# EasyEDA Pro project M0G3507逐飞主板.eprj, board pcb
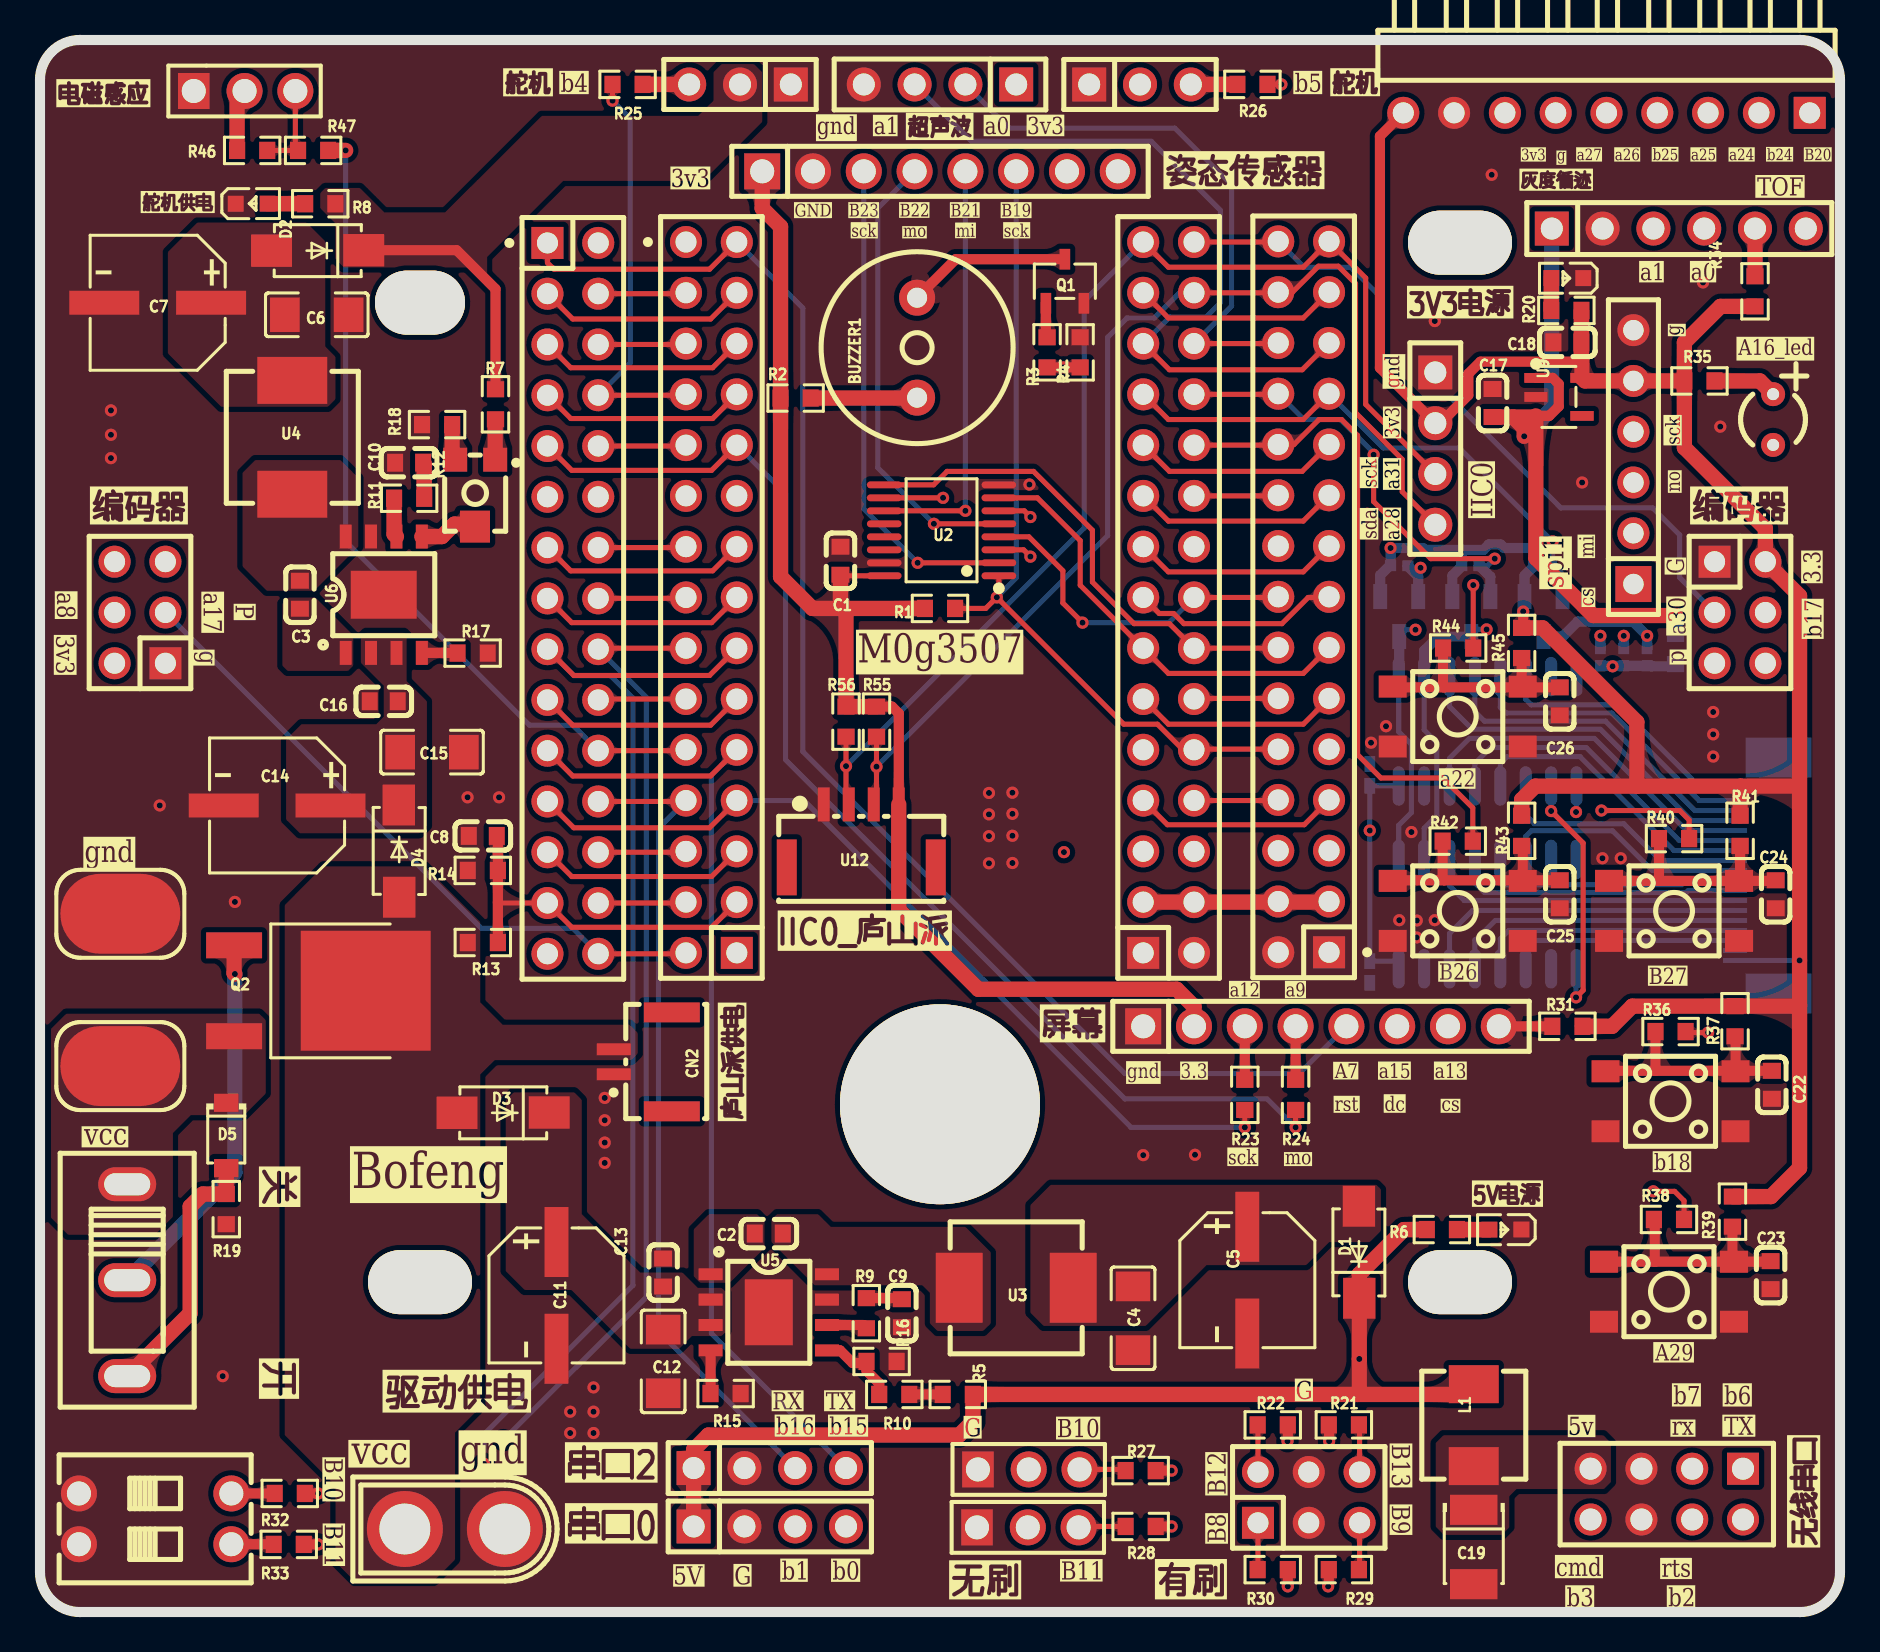
[diagram p4: board, top side]
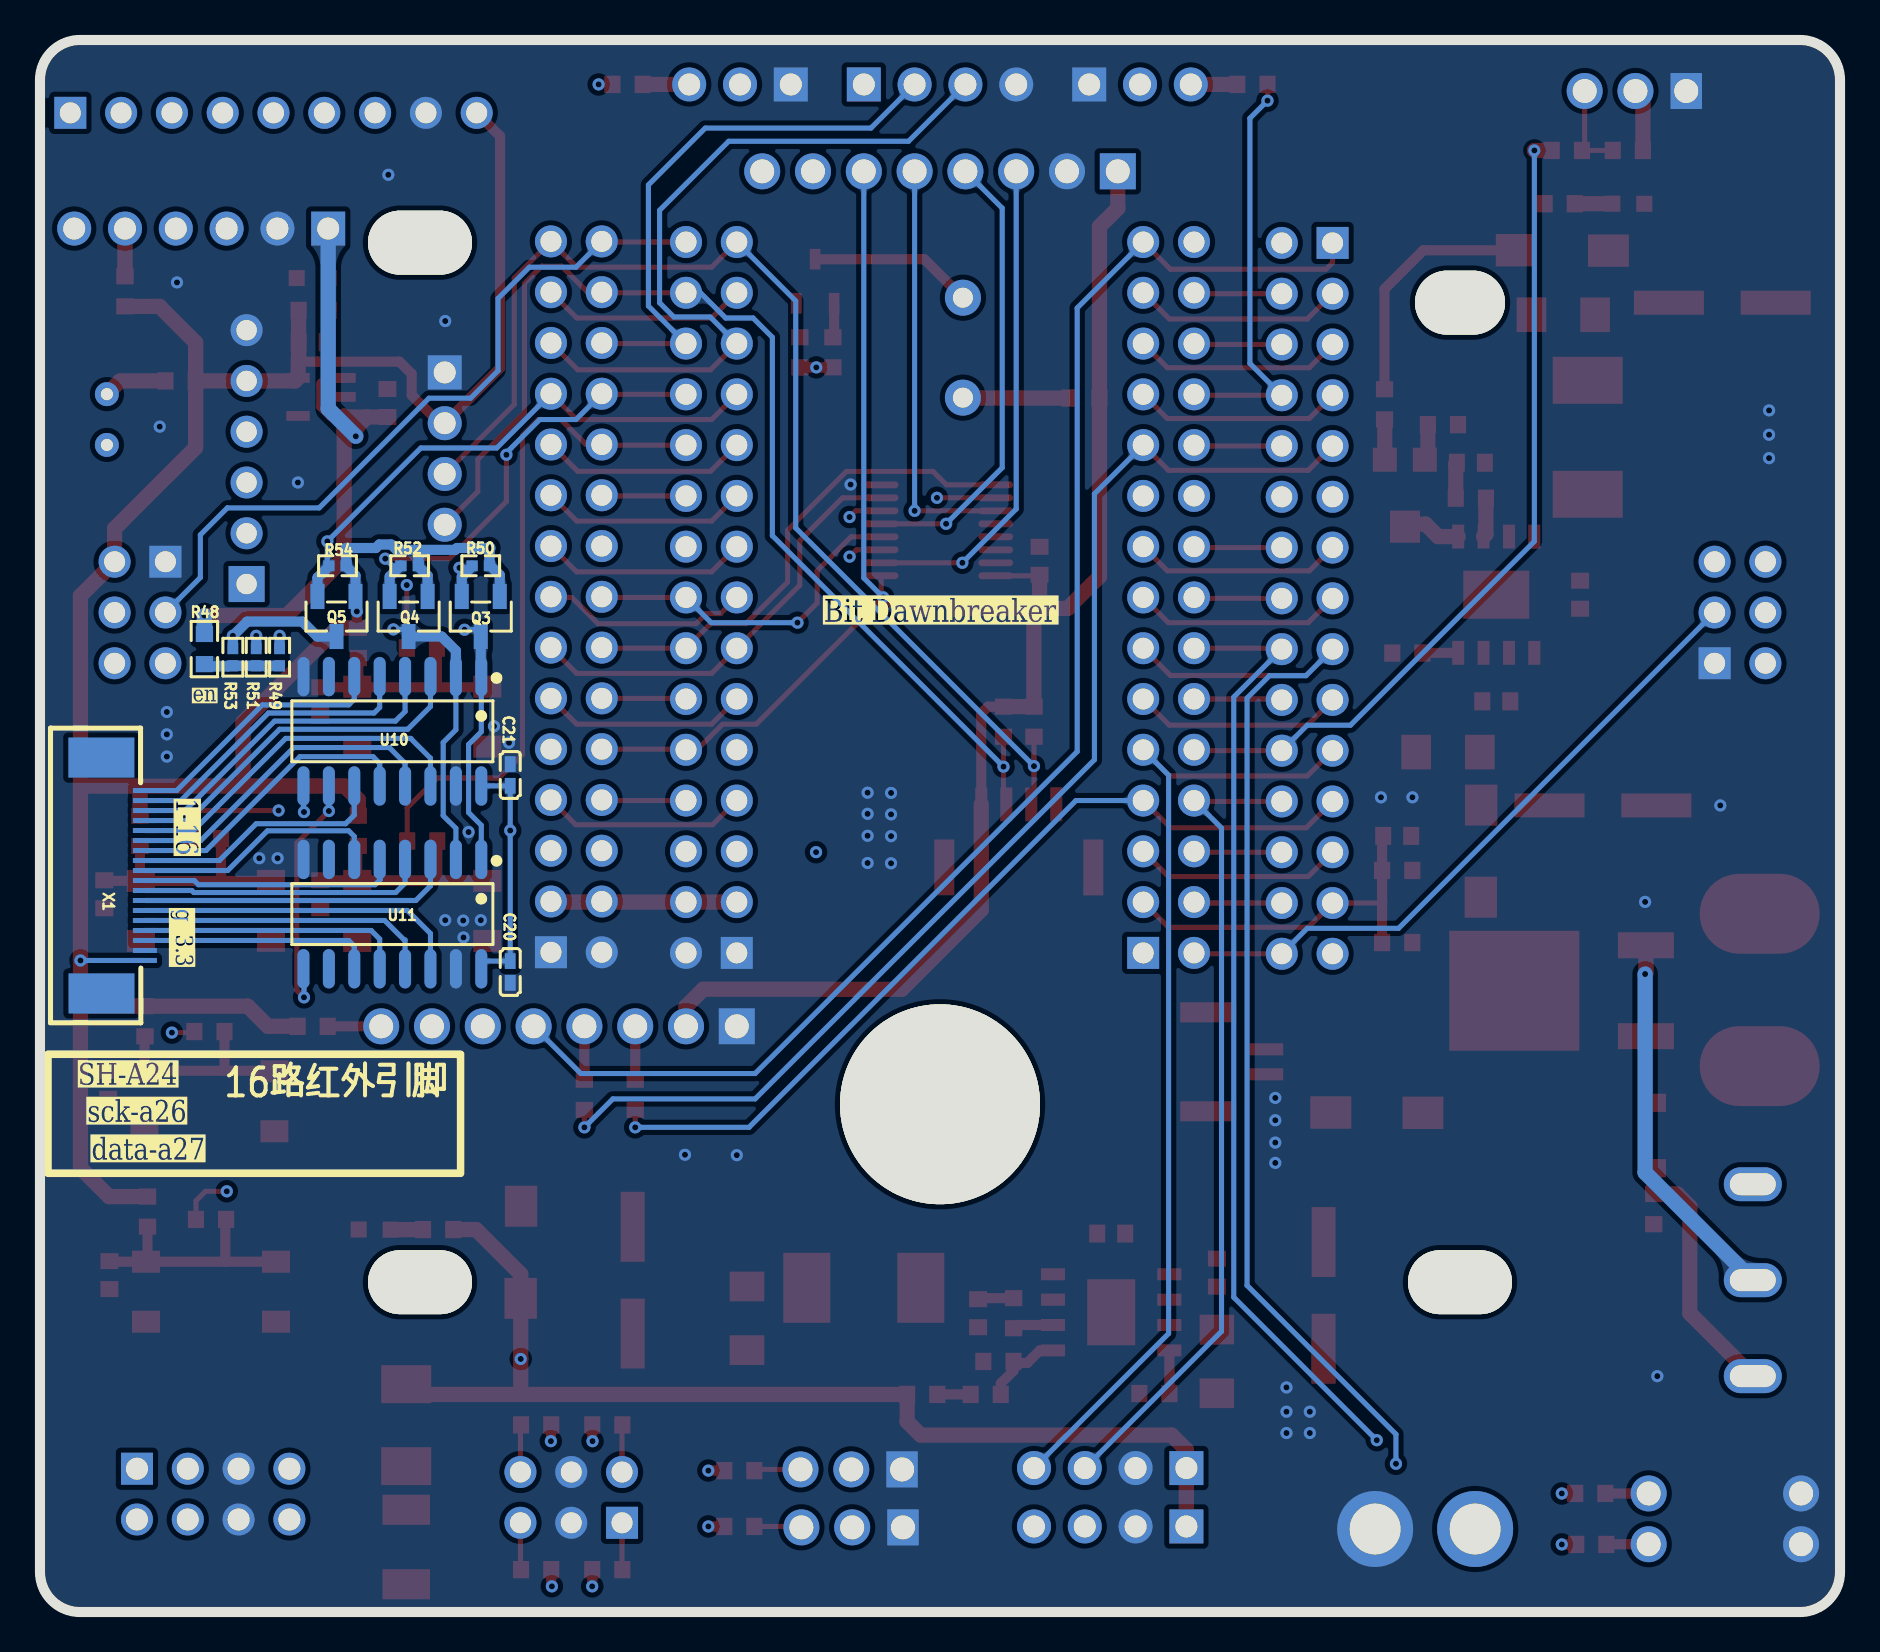
[diagram p5: board, bottom side, seen from below]

Outline 90 x 78.64 mm; copper layers: Top Layer, Inner1, Inner2, Bottom Layer. Coordinates in mm from the lower left corner of the outline.
Outline path: 0,76.64 0,2 arc(0.59,0.59) 2,0 88,0 arc(89.41,0.59) 90,2 90,76.64 arc(89.41,78.05) 88,78.64 2,78.64 arc(0.59,78.05) 0,76.64
Stack: Top Layer 0.035mm 外层铜厚1oz / Dielectric1 0.2104mm 7628 RC49% 8.6mil / Inner1 0.0152mm 内层铜厚 / Dielectric2 1.065mm 1.1mm H/HOZ Copper / Inner2 0.0152mm 内层铜厚 / Dielectric3 0.2104mm 7628 RC49% 8.6mil / Bottom Layer 0.035mm 外层铜厚1oz

## Design rules (mm)
template: 自用
spacing copperThickness1oz (default): track to track 0.102, other pairs 0.152 to 0.3
spacing copperThickness2oz: track to track 0.203, other pairs 0.152 to 0.3
track width copperThickness1oz (default): min 0.127, default 0.254, max 2.54
track width copperThickness2oz: min 0.203, default 0.254, max 2.54
track width Power_high: min 0.254, default 1.524, max 3.81
track width Power_low: min 0.254, default 0.762, max 2.54
differential pair differentialPair (default): width min 0.127, default 0.254, max 2.54; gap min 0.152, default 0.152
via viaSize (default): diameter min 0.5, default 0.61, max 10; hole min 0.3, default 0.305, max 6.299
net +5V uses Power_low
net 3V3 uses Power_low

## Placement (name value [footprint] x y rotation side)
BUZZER1  3kHz  [BUZ-TH_BD9.6-P5.00-D0.7-FD]  43.86 63.25 90 top
C1  100nF  [C0603]  40.02 52.59 270 top
C2  100nF  [C0603]  36.44 18.93 0 top
C3  100nF  [C0603]  13 50.89 90 top
C4  47uF  [C1206]  54.65 14.69 90 top
C5  100uF  [CAP-SMD_BD6.3-L6.6-W6.6-LS7.6-FD-1]  60.37 16.6 270 top
C6  47uF  [C1206]  13.84 64.89 180 top
C7  100uF  [CAP-SMD_BD6.3-L6.6-W6.6-LS7.6-FD-1]  5.88 65.49 180 top
C8  100nF  [C0603]  22.14 38.82 180 top
C9  4.7nF  [C0603]  43.09 14.95 270 top
C10  4.7nF  [C0603]  18.46 57.49 180 top
C11  100uF  [CAP-SMD_BD6.3-L6.6-W6.6-LS7.6-FD-1]  25.82 15.84 270 top
C12  4.7uF  [C1206]  31.16 12.53 90 top
C13  100nF  [C0603]  31.16 16.98 270 top
C14  100uF  [CAP-SMD_BD6.3-L6.6-W6.6-LS7.6-FD-1]  11.85 40.35 180 top
C15  4.7uF  [C1206]  19.6 43.02 180 top
C16  100nF  [C0603]  17.19 45.56 0 top
C17  10uF  [C0603]  72.63 60.48 270 top
C18  10uF  [C0603]  76.37 63.51 0 top
C19  47uF  [CASE-B_3528]  71.69 3.25 270 top
C20  100nF  [C0402]  66.49 32.02 270 bottom
C21  100nF  [C0402]  66.49 41.87 90 bottom
C22  100nF  [C0603]  86.59 26.37 90 top
C23  100nF  [C0603]  86.53 16.85 90 top
C24  100nF  [C0603]  86.78 35.9 90 top
C25  100nF  [C0603]  75.99 35.9 90 top
C26  100nF  [C0603]  75.99 45.56 90 top
CN1  XT30U-M  [CONN-TH_XT30U-M]  20.74 4.15 0 top
CN2  WAFER-GH1.25-2PWB  [CONN-TH_2P-P1.25_XUNPU_WAFER-GH1.25-2PWB]  30.14 27.52 90 top
D1  SS54  [SMA_L4.3-W2.6-LS5.0-FD]  65.96 18 270 top
D2  SS54  [SMA_L4.3-W2.6-LS5.0-FD]  13.88 68.11 0 top
D3  SS54  [SMA_L4.3-W2.6-LS5.0-FD]  23.16 24.98 0 top
D4  SS54  [SMA_L4.3-W2.6-LS5.0-FD]  17.95 38.06 90 top
D5  BZT52C16  [SOD-123_L2.7-W1.6-LS3.7-RD]  9.31 23.84 270 top
H1  X6521WV-2x15H-C60D30  [HDR-TH_30P-P2.54-V-M-R2-C15-S2.54-BL]  63.18 50.78 90 top
H2  X6521WV-2x15H-C60D30  [HDR-TH_30P-P2.54-V-M-R2-C15-S2.54-BL]  26.64 50.71 270 top
H3  -  [HDR-TH_3P-P2.54-V-M]  35 76.41 180 top
H4  -  [HDR-TH_3P-P2.54-V-M]  55 76.41 0 top
H5  PM254V-12-08-H85  [HDR-TH_8P-P2.54-V-F-R2-C4-S2.54]  81.34 5.9 180 top
H6  2.54-1*3P针  [HDR-TH_3P-P2.54-V-M-1]  49.44 7.13 0 top
H7  2.54-1*3P针  [HDR-TH_3P-P2.54-V-M-1]  49.39 4.23 0 top
H8  2.54-2*3  [HDR-TH_6P-P2.54-V-R2-C3-S2.54_A2541WV-2X3P]  63.44 5.73 0 top
H9  2.54-2*3  [HDR-TH_6P-P2.54-V-R2-C3-S2.54_A2541WV-2X3P]  5 50 90 top
H10  2.54-2*3  [HDR-TH_6P-P2.54-V-R2-C3-S2.54_A2541WV-2X3P]  85 50 270 top
H11  HC-PZ254-13.8L-1x9PWA  [HDR-TH_9P-P2.54-H-M-W10.4-N]  78.32 74.99 180 top
H12  -  [HDR-TH_4P-P2.54-V-F]  45 76.41 180 top
H13  PZ254V-11-06P  [HDR-TH_6P-P2.54-V-M]  81.94 69.2 0 top
H14  2.54-1*3P针  [HDR-TH_3P-P2.54-V-M-1]  10.23 76.09 0 top
H15  -  [HDR-TH_4P-P2.54-V-F]  69.76 58.2 270 top
H16  KH-2.54PH180-1X4P-L11.5  [HDR-TH_4P-P2.54-V-M]  36.49 4.28 0 top
H17  KH-2.54PH180-1X4P-L11.5  [HDR-TH_4P-P2.54-V-M]  36.49 7.2 0 top
H18  -  [HDR-TH_6P-P2.54-V-F]  79.67 57.77 90 top
L1  4.7uH  [IND-SMD_L5.4-W5.2_FXL0530]  71.69 9.35 270 top
LED1  19-213/Y2C-CQ2R2L/3T(CY)  [LED0603-RD-YELLOW]  73.27 19.13 180 top
LED2  19-213/Y2C-CQ2R2L/3T(CY)  [LED0603-RD-YELLOW]  10.58 70.45 0 top
LED3  KT-0603R  [LED0603-RD]  76.37 66.73 180 top
LED4  TLHR4200  [LED-TH_BD3.2-P2.54-FD]  86.66 59.65 270 top
NOREF  -  [Pad_e3680]  19 16.5 90 top
NOREF#2  -  [Pad_e3679]  71 68.5 90 top
NOREF#3  -  [Pad_e2316]  45 25.4 0 top
NOREF#4  -  [Pad_e3681]  71 16.5 90 top
NOREF#5  -  [Pad_e3675]  19 65.5 90 top
P1  2.54-1*8P母环保  [HDR-TH_8P-P2.54-V-F-1]  64.05 29.3 0 top
P2  2.54-1*8P母环保  [HDR-TH_8P-P2.54-V-F-1]  45 72.07 0 top
Q1  S8050 J3Y(RANGE:200-350)  [SOT-23-3_L3.0-W1.7-P0.95-LS2.9-BR]  51.24 66.57 270 top
Q2  HY19P03D  [TO-252-2_L6.6-W6.1-P4.57-LS9.9-TL-CW]  13 31.08 0 top
Q3  AO3400A  [SOT-23-3_L2.9-W1.3-P1.90-LS2.4-BR]  67.96 49.8 90 bottom
Q4  AO3400A  [SOT-23-3_L2.9-W1.3-P1.90-LS2.4-BR]  71.57 49.8 90 bottom
Q5  AO3400A  [SOT-23-3_L2.9-W1.3-P1.90-LS2.4-BR]  75.18 49.8 90 bottom
R1  10K  [R0603]  45 50.2 180 top
R2  10Ω  [R0603]  37.78 60.73 0 top
R3  4.7kΩ  [R0603]  50.35 63.01 90 top
R4  4.7kΩ  [R0603]  52 63.01 90 top
R5  51kΩ  [R0603]  45.89 10.88 0 top
R6  10k  [R0603]  70.09 19.13 180 top
R7  27k  [R0603]  22.78 60.41 90 top
R8  10k  [R0603]  14.01 70.45 0 top
R9  20kΩ  [R0603]  41.32 14.95 270 top
R10  1.5kΩ  [R0603]  42.71 10.88 0 top
R11  20kΩ  [R0603]  18.46 55.72 180 top
R12  50K  [RES-ADJ-SMD_3P-L3.8-W3.7_VGF39NCHXT]  21.76 55.97 90 top
R13  10K  [R0603]  22.14 33.49 0 top
R14  1k  [R0603]  22.14 37.1 180 top
R15  200kΩ  [R0603]  34.28 10.93 0 top
R16  10kΩ  [R0603]  42.08 12.53 180 top
R17  200kΩ  [R0603]  21.63 47.97 0 top
R18  8.2  [R0603]  19.85 59.4 0 top
R19  10kΩ  [R0603]  9.31 20.16 90 top
R20  4.7kΩ  [R0603]  76.32 65.11 0 top
R21  100Ω  [R0603]  65.19 9.36 0 top
R22  100Ω  [R0603]  61.64 9.36 0 top
R23  100Ω  [R0603]  60.24 25.87 90 top
R24  100Ω  [R0603]  62.78 25.87 90 top
R25  10K  [R0603]  29.38 76.42 180 top
R26  10K  [R0603]  60.62 76.42 0 top
R27  100Ω  [R0603]  55.03 7.07 180 top
R28  100Ω  [R0603]  55.03 4.28 180 top
R29  100Ω  [R0603]  65.19 2.12 0 top
R30  100Ω  [R0603]  61.64 2.12 0 top
R31  1KΩ  [R0603]  76.37 29.3 0 top
R32  100Ω  [R0603]  12.49 5.93 180 top
R33  100Ω  [R0603]  12.44 3.38 180 top
R34  10K  [R0603]  85.75 66.06 270 top
R35  10K  [R0603]  82.97 61.58 0 top
R36  100Ω  [R0603]  81.53 29.04 0 top
R37  10K  [R0603]  84.75 29.55 90 top
R38  100Ω  [R0603]  81.45 19.64 0 top
R39  10K  [R0603]  84.62 20.03 90 top
R40  100Ω  [R0603]  81.7 38.69 0 top
R41  10K  [R0603]  85 39.08 90 top
R42  100Ω  [R0603]  70.89 38.56 0 top
R43  10K  [R0603]  74.08 39.08 90 top
R44  100Ω  [R0603]  70.91 48.22 0 top
R45  10K  [R0603]  74.08 48.48 90 top
R46  10KΩ  [R0603]  10.61 73.11 180 top
R47  100  [R0603]  13.66 73.11 0 top
R48  10K  [R0603]  81.78 48.17 90 bottom
R49  10K  [R0402]  78.02 47.77 270 bottom
R50  4.7K  [R0402]  67.96 52.34 180 bottom
R51  10K  [R0402]  79.19 47.77 270 bottom
R52  4.7K  [R0402]  71.52 52.34 180 bottom
R53  10K  [R0402]  80.36 47.77 270 bottom
R54  4.7K  [R0402]  75.12 52.34 180 bottom
R55  1.5K  [R0603]  41.82 44.54 90 top
R56  1.5K  [R0603]  40.3 44.54 90 top
SW1  SS12D10G6  [SW-TH_SHOU-HAN_SS12D10G4]  4.36 16.6 270 top
SW2  DSWB02LHGET  [SW-TH_DSWB02LHGET]  5.76 4.66 270 top
SW3  KH-4.5X4.5X3.8H-STM  [SW-SMD_4P-L4.5-W4.5-P3.00-LS6.8]  81.53 25.55 0 top
SW4  KH-4.5X4.5X3.8H-STM  [SW-SMD_4P-L4.5-W4.5-P3.00-LS6.8]  81.45 16.02 0 top
SW5  KH-4.5X4.5X3.8H-STM  [SW-SMD_4P-L4.5-W4.5-P3.00-LS6.8]  81.7 35.07 0 top
SW6  KH-4.5X4.5X3.8H-STM  [SW-SMD_4P-L4.5-W4.5-P3.00-LS6.8]  70.89 35.07 0 top
SW7  KH-4.5X4.5X3.8H-STM  [SW-SMD_4P-L4.5-W4.5-P3.00-LS6.8]  70.89 44.79 0 top
U1  -  [MSPM0G3507]  45 50.91 180 top
U2  CH440R  [TSSOP-16_L5.0-W4.4-P0.65-LS6.4-BL]  45.08 54.11 90 top
U3  4.7uH  [IND-SMD_L7.2-W6.6_GPSR07X0]  48.81 16.22 0 top
U4  4.7uH  [IND-SMD_L7.2-W6.6_GPSR07X0]  12.61 58.76 90 top
U5  SCT2450STER  [ESOP-8_L4.9-W3.9-P1.27-LS6.0-BL-EP]  36.44 14.99 270 top
U6  SCT2450STER  [ESOP-8_L4.9-W3.9-P1.27-LS6.0-BL-EP]  17.19 50.89 0 top
U7  -  [WIREPAD-4X6]  4.02 27.31 0 top
U8  -  [WIREPAD-4X6]  4.02 34.93 0 top
U9  RT9013-33GB  [SOT-23-5_L3.0-W1.7-P0.95-LS2.8-BL]  75.95 60.78 270 top
U10  SN74LS165ADR  [SOIC-16_L9.9-W3.9-P1.27-LS6.0-BL]  72.38 44.06 0 bottom
U11  SN74LS165ADR  [SOIC-16_L9.9-W3.9-P1.27-LS6.0-BL]  72.38 34.91 0 bottom
U12  WAFER-GH1.25-4PWB  [CONN-SMD_4P-P1.25_XUNPU_WAFER-GH1.25-4PWB]  41.06 38.82 0 top
X1  AFC07-S18FCA-00  [FPC-SMD_AFC07-S18FCA-00]  85.84 36.84 270 bottom

## Footprints (pads in the part's own frame, mm; a bottom-side part is the same pattern mirrored in y, then rotated)
BUZ-TH_BD9.6-P5.00-D0.7-FD
  round 1.8 hole 1: 1(-2.5,0) 2(2.5,0)
C0402
  rect 0.79x0.54 smd: 1(-0.545,0) 2(0.545,0)
C0603
  rect 0.8x0.9 smd: 1(-0.7,0) 2(0.7,0)
C1206
  rect 1.485x1.728 smd: 1(-1.593,0) 2(1.593,0)
CAP-SMD_BD6.3-L6.6-W6.6-LS7.6-FD-1
  rect 3.5x1.2 smd: 1(-2.67,0) 2(2.67,0)
CASE-B_3528
  rect 1.506x2.376 smd: 1(-1.861,0) 2(1.861,0)
CONN-SMD_4P-P1.25_XUNPU_WAFER-GH1.25-4PWB
  rect 0.6x1.7 smd: 1(-1.875,1.575) 2(-0.625,1.575) 3(0.625,1.575) 4(1.875,1.575)
  rect 1x2.8 smd: 5(3.725,-1.575) 6(-3.725,-1.575)
CONN-TH_2P-P1.25_XUNPU_WAFER-GH1.25-2PWB
  rect 0.6x1.7 smd: 1(-0.625,1.45) 2(0.625,1.45)
  rect 1x2.8 smd: 3(-2.475,-1.45) 4(2.475,-1.45)
CONN-TH_XT30U-M
  round 3.8 hole 2.54: 1(-2.5,0) 2(2.5,0)
ESOP-8_L4.9-W3.9-P1.27-LS6.0-BL-EP
  rect 0.6x1.2 smd: 1(-1.905,-2.909) 2(-0.635,-2.909) 3(0.635,-2.909) 4(1.905,-2.909) 5(1.905,2.909) 6(0.635,2.909) 7(-0.635,2.909) 8(-1.905,2.909)
  rect 3.3x2.4 smd: 9(0,0)
FPC-SMD_AFC07-S18FCA-00
  rect 0.25x1.2 smd: 1(-4.25,1.089) 2(-3.75,1.089) 3(-3.25,1.089) 4(-2.75,1.089) 5(-2.25,1.089) 6(-1.75,1.089) 7(-1.25,1.089) 8(-0.75,1.089) 9(-0.25,1.089) 10(0.25,1.089) 11(0.75,1.089) 12(1.25,1.089) 13(1.75,1.089) 14(2.25,1.089) 15(2.75,1.089) 16(3.25,1.089) 17(3.75,1.089) 18(4.25,1.089)
  rect 2x3.3 smd: 19(5.901,-1.081) 20(-5.901,-1.089)
HDR-TH_3P-P2.54-V-M
  rect 1.7x1.7 hole 1.1: 1(-2.54,0)
  round 1.7 hole 1.1: 2(0,0) 3(2.54,0)
HDR-TH_3P-P2.54-V-M-1
  rect 1.575x1.8 hole 1.2: 1(-2.54,0)
  round 1.8 hole 1.2: 2(0,0) 3(2.54,0)
HDR-TH_4P-P2.54-V-F
  rect 1.7x1.7 hole 1.1: 1(-3.81,0)
  round 1.7 hole 1.1: 2(-1.27,0) 3(1.27,0) 4(3.81,0)
HDR-TH_4P-P2.54-V-M
  rect 1.7x1.7 hole 1.1: 1(-3.81,0)
  round 1.7 hole 1.1: 2(-1.27,0) 3(1.27,0) 4(3.81,0)
HDR-TH_6P-P2.54-V-F
  rect 1.8x1.8 hole 1.02: 1(-6.35,0)
  round 1.6 hole 1.02: 2(-3.81,0) 3(-1.27,0) 4(1.27,0) 5(3.81,0) 6(6.35,0)
HDR-TH_6P-P2.54-V-M
  rect 1.7x1.7 hole 1.1: 1(-6.35,0)
  round 1.7 hole 1.1: 2(-3.81,0) 3(-1.27,0) 4(1.27,0) 5(3.81,0) 6(6.35,0)
HDR-TH_6P-P2.54-V-R2-C3-S2.54_A2541WV-2X3P
  rect 1.6x1.6 hole 1.05: 1(-2.54,-1.27)
  round 1.6 hole 1.05: 2(-2.54,1.27) 3(0,-1.27) 4(0,1.27) 5(2.54,-1.27) 6(2.54,1.27)
HDR-TH_8P-P2.54-V-F-1
  rect 1.8x1.8 hole 1.2: 1(-8.89,0)
  round 1.8 hole 1.2: 2(-6.35,0) 3(-3.81,0) 4(-1.27,0) 5(1.27,0) 6(3.81,0) 7(6.35,0) 8(8.89,0)
HDR-TH_8P-P2.54-V-F-R2-C4-S2.54
  rect 1.6x1.6 hole 1.1: 1(-3.81,-1.27)
  round 1.6 hole 1.1: 2(-3.81,1.27) 3(-1.27,-1.27) 4(-1.27,1.27) 5(1.27,-1.27) 6(1.27,1.27) 7(3.81,-1.27) 8(3.81,1.27)
HDR-TH_9P-P2.54-H-M-W10.4-N
  rect 1.6x1.6 hole 1.05: 1(-10.16,0)
  round 1.6 hole 1.05: 2(-7.62,0) 3(-5.08,0) 4(-2.54,0) 5(0,0) 6(2.54,0) 7(5.08,0) 8(7.62,0) 9(10.16,0)
HDR-TH_30P-P2.54-V-M-R2-C15-S2.54-BL
  rect 1.6x1.6 hole 1.05: 1(-17.78,-1.27)
  round 1.6 hole 1.05: 2(-17.78,1.27) 3(-15.24,-1.27) 4(-15.24,1.27) 5(-12.7,-1.27) 6(-12.7,1.27) 7(-10.16,-1.27) 8(-10.16,1.27) 9(-7.62,-1.27) 10(-7.62,1.27) 11(-5.08,-1.27) 12(-5.08,1.27) 13(-2.54,-1.27) 14(-2.54,1.27) 15(0,-1.27) 16(0,1.27) 17(2.54,-1.27) 18(2.54,1.27) 19(5.08,-1.27) 20(5.08,1.27) 21(7.62,-1.27) 22(7.62,1.27) 23(10.16,-1.27) 24(10.16,1.27) 25(12.7,-1.27) 26(12.7,1.27) 27(15.24,-1.27) 28(15.24,1.27) 29(17.78,-1.27) 30(17.78,1.27)
IND-SMD_L5.4-W5.2_FXL0530
  rect 1.9x2.5 smd: 1(-2.05,0) 2(2.05,0)
IND-SMD_L7.2-W6.6_GPSR07X0
  rect 2.35x3.5 smd: 1(-2.85,0) 2(2.85,0)
LED0603-RD
  rect 0.8x0.8 smd: 1(-0.799,0) 2(0.799,0)
LED0603-RD-YELLOW
  rect 0.8x0.8 smd: 1(-0.799,-0.004) 2(0.799,0.004)
LED-TH_BD3.2-P2.54-FD
  round 1.2 hole 0.6: 1(-1.27,0) 2(1.27,0)
MSPM0G3507
  round 1.6 hole 1.05: 1(-12.7,17.938) 3(-12.7,15.398) 4(-10.16,15.398) 5(-12.7,12.858) 6(-10.16,12.858) 7(-12.7,10.318) 8(-10.16,10.318) 9(-12.7,7.778) 10(-10.16,7.778) 11(-12.7,5.238) 12(-10.16,5.238) 13(-12.7,2.698) 14(-10.16,2.698) 15(-12.7,0.158) 16(-10.16,0.158) 17(-12.7,-2.382) 18(-10.16,-2.382) 19(-12.7,-4.922) 20(-10.16,-4.922) 21(-12.7,-7.462) 22(-10.16,-7.462) 23(-12.7,-10.002) 24(-10.16,-10.002) 25(-12.7,-12.542) 26(-10.16,-12.542) 27(-12.7,-15.082) 28(-10.16,-15.082) 29(-12.7,-17.622) 30(-10.16,-17.622) 31(12.7,-17.622) 32(10.16,-17.622) 33(12.7,-15.082) 34(10.16,-15.082) 35(12.7,-12.542) 36(10.16,-12.542) 37(12.7,-10.002) 38(10.16,-10.002) 39(12.7,-7.462) 40(10.16,-7.462) 41(12.7,-4.922) 42(10.16,-4.922) 43(12.7,-2.382) 44(10.16,-2.382) 45(12.7,0.158) 46(10.16,0.158) 47(12.7,2.698) 48(10.16,2.698) 49(12.7,5.238) 50(10.16,5.238) 51(12.7,7.778) 52(10.16,7.778) 53(12.7,10.318) 54(10.16,10.318) 55(12.7,12.858) 56(10.16,12.858) 57(12.7,15.398) 58(10.16,15.398) 59(12.7,17.938)
  rect 1.6x1.6 hole 1.05: 2(-10.16,17.938) 60(10.16,17.938)
Pad_e2316
  round 10 hole 10: 1(0,0)
Pad_e3675
  oval 3.2x4.5 hole 3.2x4.5: 1(0,0)
Pad_e3679
  oval 3.2x5.2 hole 3.2x5.2: 1(0,0)
Pad_e3680
  oval 3.2x5.2 hole 3.2x5.2: 1(0,0)
Pad_e3681
  oval 3.2x5.2 hole 3.2x5.2: 1(0,0)
R0402
  rect 0.566x0.54 smd: 1(-0.433,0) 2(0.433,0)
R0603
  rect 0.806x0.864 smd: 1(-0.753,0) 2(0.753,0)
RES-ADJ-SMD_3P-L3.8-W3.7_VGF39NCHXT
  rect 1.2x1.2 smd: 1(1.675,-1) 3(1.675,1)